# EasyEDA Pro project core_board.eprj (continued)
## Notes on the sheets (continued)
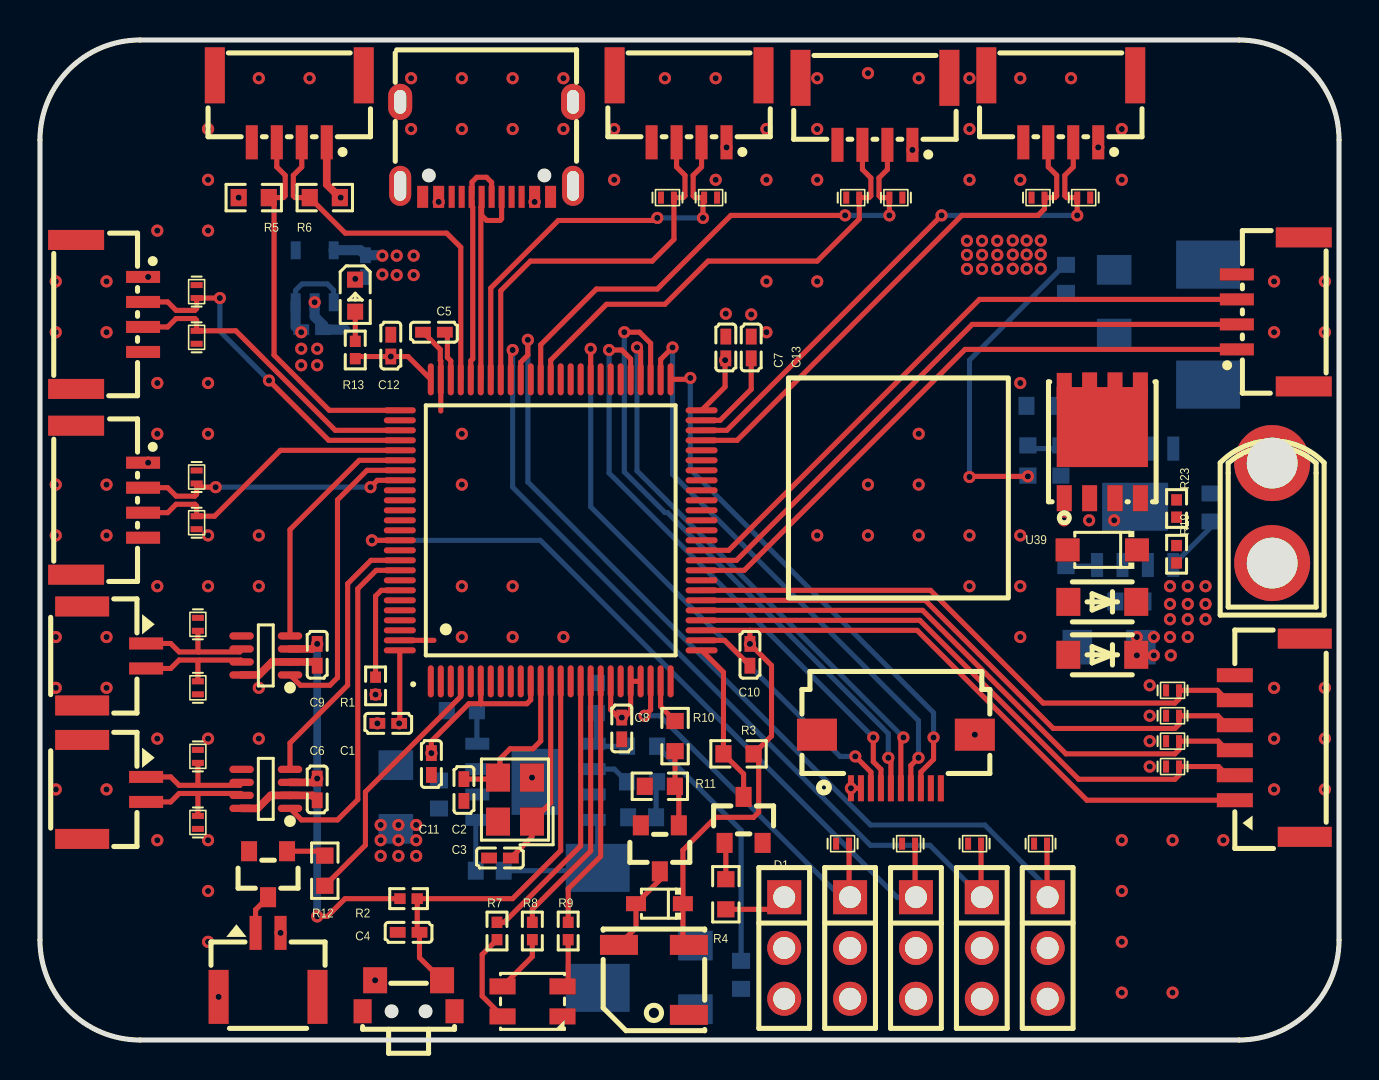
[diagram p2: board, top side]
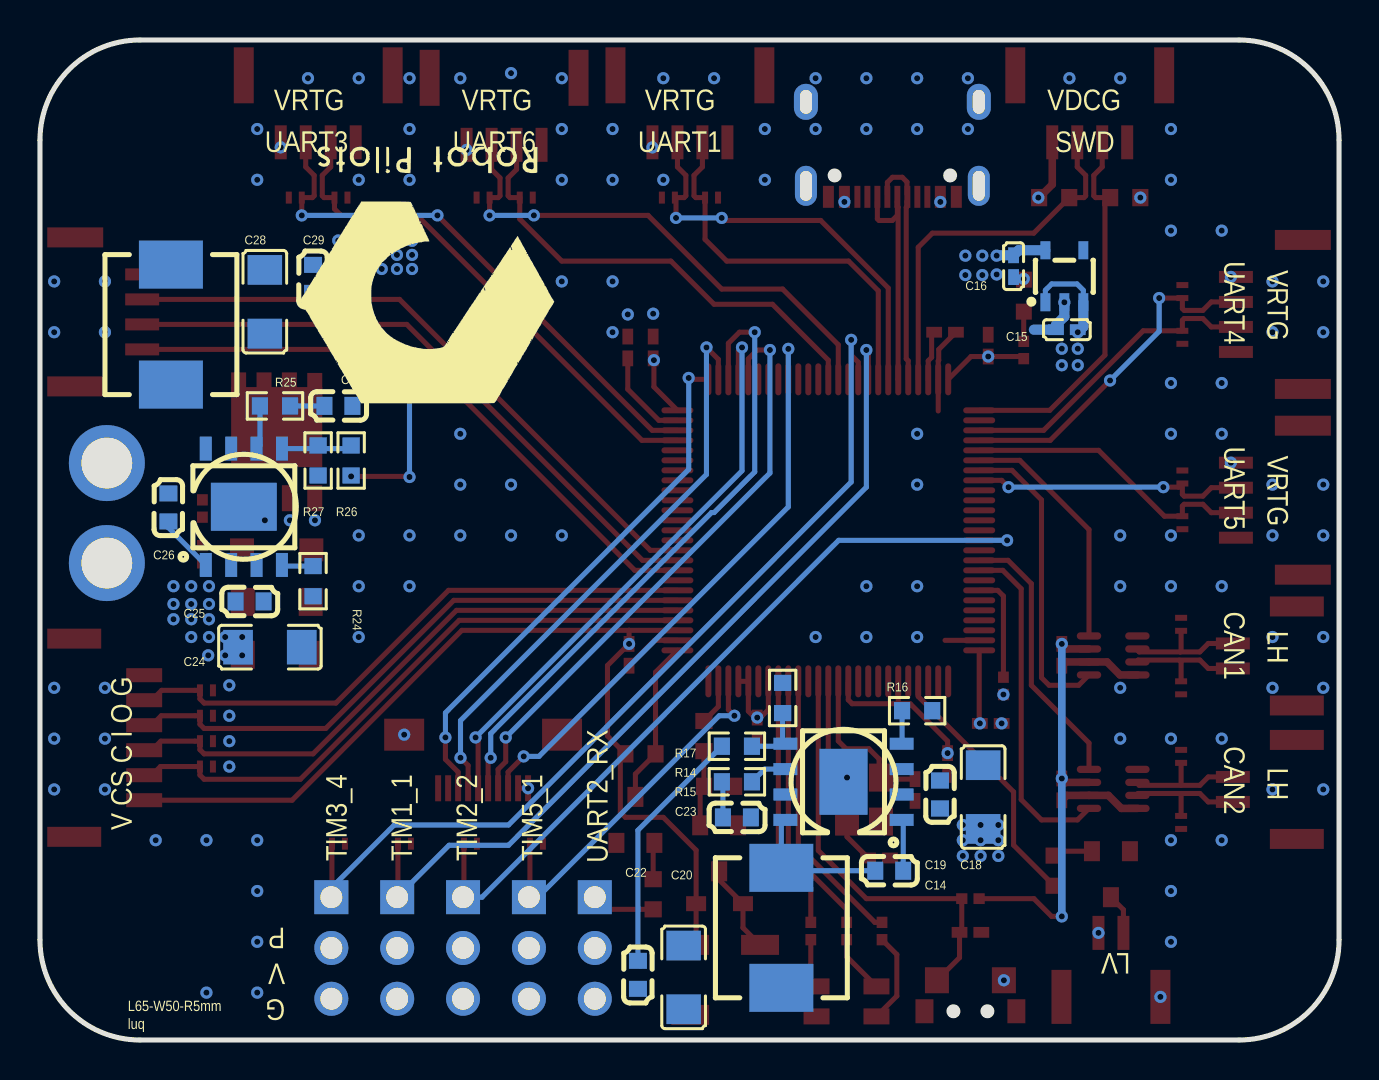
[diagram p3: board, bottom side, seen from below]

Outline 65 x 50 mm; copper layers: Top Layer, VCC, GND, Bottom Layer. Coordinates in mm from the lower left corner of the outline.
Outline path: 0,45 arc(1.46,48.54) 5,50 60,50 arc(63.54,48.54) 65,45 65,5 arc(63.54,1.46) 60,0 5,0 arc(1.46,1.46) 0,5 0,45
Stack: Top Layer 0.035mm 外层铜厚1oz / Dielectric1 0.2104mm 7628 RC49% 8.6mil / VCC 0.0152mm 内层铜厚 / Dielectric2 1.065mm 1.1mm H/HOZ 含铜 / GND 0.0152mm 内层铜厚 / Dielectric3 0.2104mm 7628 RC49% 8.6mil / Bottom Layer 0.035mm 外层铜厚1oz

## Design rules (mm)
net CAN2_L: DP8
net CAN2_H: DP8
net CAN1_L: DP7
net CAN1_H: DP7
net USB_DP: DP9
net USB_DN: DP9
template: 自定义配置
spacing copperThickness1oz (default): track to track 0.102, other pairs 0.152 to 0.3
spacing copperThickness2oz: track to track 0.203, other pairs 0.152 to 0.3
spacing 6mil: track to track 0.102, other pairs 0.152 to 0.152
track width copperThickness1oz (default): min 0.127, default 0.254, max 2.54
track width copperThickness2oz: min 0.203, default 0.254, max 2.54
track width 10mil: min 0.254, default 0.254, max 2.54
track width 20mil: min 0.508, default 0.508, max 2.54
differential pair differentialPair (default): width min 0.127, default 0.254, max 2.54; gap min 0.152, default 0.152
differential pair err=5mil: width min 0.127, default 0.254, max 2.54; gap min 0.152, default 0.254
via viaSize: diameter min 0.5, default 0.61, max 10; hole min 0.3, default 0.305, max 6.299
via 12-24 (default): diameter min 0.5, default 0.61, max 10; hole min 0.3, default 0.305, max 6.299

## Placement (name value [footprint] x y rotation side)
C1  4.7uF  [C0402]  17.43 15.83 180 top
C2  20pF  [C0402]  21.21 12.5 90 top
C3  20pF  [C0402]  23.02 9.1 180 top
C4  100nF  [C0402]  18.44 5.38 0 top
C5  10uF  [C0402]  19.71 35.39 0 top
C6  100nF  [C0402]  13.87 12.53 90 top
C7  100nF  [C0402]  34.32 34.63 270 top
C8  100nF  [C0402]  29.11 15.58 90 top
C9  100nF  [C0402]  13.87 19.26 90 top
C10  100nF  [C0402]  35.52 19.26 90 top
C11  100nF  [C0402]  19.59 13.8 90 top
C12  100nF  [C0402]  17.55 34.72 270 top
C13  10uF  [C0402]  35.59 34.63 90 top
C14  100nF  [C0603]  22.51 8.47 0 bottom
C15  100nF  [C0402]  13.62 35.52 180 bottom
C16  100nF  [C0402]  16.28 38.69 90 bottom
C18  47uF  [C1206]  17.81 12.15 90 bottom
C19  100nF  [C0603]  19.97 12.28 270 bottom
C20  47uF  [C1206]  32.79 3.13 90 bottom
C22  100nF  [C0603]  35.08 3.26 90 bottom
C23  3.3nF  [C0603]  30.13 11.13 0 bottom
C24  47uF  [C1206]  53.49 19.64 180 bottom
C25  100nF  [C0603]  54.51 21.93 0 bottom
C26  100nF  [C0603]  58.58 26.63 90 bottom
C27  3.3nF  [C0603]  50.07 31.71 0 bottom
C28  47uF  [C1206]  53.75 36.91 90 bottom
C29  100nF  [C0603]  51.34 38.06 90 bottom
CN1  L125WVS-02PW  [CONN-SMD_2P-P1.25_DELON_L125WVS-02PW]  3.71 12.53 270 top
CN2  L125WVS-02PW  [CONN-SMD_2P-P1.25_DELON_L125WVS-02PW]  3.71 19.2 270 top
CN3  L125WVS-02PW  [CONN-SMD_2P-P1.25_DELON_L125WVS-02PW]  11.41 3.76 0 top
CN4  XT30U-M  [CONN-TH_XT30U-M]  61.65 26.35 90 top
D1  1N4148WS  [SOD-323_L1.8-W1.3-LS2.5-RD]  31 6.82 180 top
FPC1  AFC01-S10FCA-00  [FPC-SMD_P0.5-10P_FGS-XJ-H2.0]  42.83 13.93 0 top
H1  -  [HDR-TH_3P-P2.54-V-M]  40.53 4.6 270 top
H2  -  [HDR-TH_3P-P2.54-V-M]  47.13 4.6 270 top
H3  -  [HDR-TH_3P-P2.54-V-M]  50.42 4.6 270 top
H4  -  [HDR-TH_3P-P2.54-V-M]  43.83 4.6 270 top
H5  -  [HDR-TH_3P-P2.54-V-M]  37.24 4.6 270 top
L1  6.8uH  [IND-SMD_L7.0-W6.6]  27.9 5.61 270 bottom
L2  6.8uH  [IND-SMD_L7.0-W6.6]  58.45 35.77 90 bottom
LED1  MHPC3528CRGBCT  [LED-SMD_4P-L3.2-W2.8-BL]  24.64 1.93 0 top
LED2  -  [LED_0603]  15.78 37.17 270 top
Q1  -  [S8050_SOT-23]  35.08 11.01 270 top
Q2  -  [S8050_SOT-23]  31.14 9.58 90 top
Q3  -  [S8050_SOT-23]  11.54 8.29 90 top
Q4  XC6220B331MR-G  [SOT-25_L3.0-W1.6-P0.95-LS2.8-TL]  13.74 38.19 90 bottom
Q5  BSC0702LS  [PG-TDSON-8_L5.0-W6.0-P1.27-BL-EP]  53.15 29.91 0 top
R1  10K  [R0402]  16.79 17.71 270 top
R2  10K  [R0402]  18.44 7.07 180 top
R3  4.7K  [R0603]  34.95 14.31 0 top
R4  4.7K  [R0603]  34.32 7.29 270 top
R5  10K  [R0603]  10.7 42.12 180 top
R6  10K  [R0603]  14.25 42.12 0 top
R7  100R  [R0402]  22.87 5.45 90 top
R8  100R  [R0402]  24.64 5.45 90 top
R9  100R  [R0402]  26.43 5.45 90 top
R10  1K  [R0603]  31.78 15.2 90 top
R11  10K  [R0603]  31.02 12.69 0 top
R12  4.7K  [R0603]  14.25 8.47 90 top
R13  100R  [R0402]  15.78 34.5 270 top
R14  50K  [R0603]  30.13 14.69 0 bottom
R15  33K  [R0603]  30.13 12.91 180 bottom
R16  200K  [R0603]  21.11 16.47 0 bottom
R17  10K  [R0603]  27.84 17.1 270 bottom
R19  50K  [R0402]  56.87 24.29 270 top
R23  10K  [R0402]  56.87 26.57 90 top
R24  200K  [R0603]  51.34 22.94 90 bottom
R25  33K  [R0603]  53.24 31.7 0 bottom
R26  50K  [R0603]  49.43 28.98 270 bottom
R27  10K  [R0603]  51.08 28.98 90 bottom
SW1  TS24CA  [SW-SMD_TS24CA]  18.44 2.21 180 top
U1  STM32F407VET6  [LQFP-100_L14.0-W14.0-P0.50-LS16.0-BL]  25.55 25.48 0 top
U2  PESD5V0F1BL  [SOD-882_L1.0-W0.6-BI]  40.16 9.82 0 top
U3  WAFER-GH1.25-4PLB  [CONN-SMD_4P-P1.25_XUNPU_WAFER-GH1.25-4PLB]  32.48 46.56 180 top
U4  WAFER-GH1.25-4PLB  [CONN-SMD_4P-P1.25_XUNPU_WAFER-GH1.25-4PLB]  51.08 46.56 180 top
U5  PESD5V0F1BL  [SOD-882_L1.0-W0.6-BI]  31.4 42.12 0 top
U6  PESD5V0F1BL  [SOD-882_L1.0-W0.6-BI]  33.56 42.12 180 top
U7  PESD5V0F1BL  [SOD-882_L1.0-W0.6-BI]  49.94 42.12 0 top
U8  PESD5V0F1BL  [SOD-882_L1.0-W0.6-BI]  52.23 42.12 180 top
U9  PESD5V0F1BL  [SOD-882_L1.0-W0.6-BI]  46.76 9.82 0 top
U10  WAFER-GH1.25-4PLB  [CONN-SMD_4P-P1.25_XUNPU_WAFER-GH1.25-4PLB]  3.48 36.28 270 top
U11  WAFER-GH1.25-4PLB  [CONN-SMD_4P-P1.25_XUNPU_WAFER-GH1.25-4PLB]  3.48 26.99 270 top
U12  PESD5V0F1BL  [SOD-882_L1.0-W0.6-BI]  50.07 9.82 0 top
U13  PESD5V0F1BL  [SOD-882_L1.0-W0.6-BI]  7.84 35.14 90 top
U14  PESD5V0F1BL  [SOD-882_L1.0-W0.6-BI]  7.84 37.42 270 top
U15  PESD5V0F1BL  [SOD-882_L1.0-W0.6-BI]  7.84 25.86 90 top
U16  PESD5V0F1BL  [SOD-882_L1.0-W0.6-BI]  7.84 28.15 270 top
U17  PESD5V0F1BL  [SOD-882_L1.0-W0.6-BI]  43.46 9.82 0 top
U18  WAFER-GH1.25-4PLB  [CONN-SMD_4P-P1.25_XUNPU_WAFER-GH1.25-4PLB]  41.78 46.43 180 top
U19  WAFER-GH1.25-4PLB  [CONN-SMD_4P-P1.25_XUNPU_WAFER-GH1.25-4PLB]  61.56 36.41 90 top
U20  PESD5V0F1BL  [SOD-882_L1.0-W0.6-BI]  40.67 42.12 0 top
U21  PESD5V0F1BL  [SOD-882_L1.0-W0.6-BI]  42.83 42.12 180 top
U22  WAFER-GH1.25-4PLB  [CONN-SMD_4P-P1.25_XUNPU_WAFER-GH1.25-4PLB]  12.47 46.56 180 top
U23  MAX3051EKA+T  [SOT-23-8_L3.0-W1.7-P0.65-LS2.8-TL]  11.3 12.56 180 top
U24  KLJ-5025-5040  [BUZ-SMD_3P-L5.0-W5.0-BL]  30.72 3.01 180 top
U25  PESD5V0F1BL  [SOD-882_L1.0-W0.6-BI]  7.9 14.18 270 top
U26  PESD5V0F1BL  [SOD-882_L1.0-W0.6-BI]  7.9 10.88 90 top
U27  MAX3051EKA+T  [SOT-23-8_L3.0-W1.7-P0.65-LS2.8-TL]  11.3 19.23 180 top
U28  HC-GH-6PWT  [CONN-SMD_6P-P1.25_HCTL_HC-GH-6PWT]  61.54 15.11 90 top
U29  PESD5V0F1BL  [SOD-882_L1.0-W0.6-BI]  7.9 20.78 270 top
U30  PESD5V0F1BL  [SOD-882_L1.0-W0.6-BI]  7.9 17.61 90 top
U31  PESD5V0F1BL  [SOD-882_L1.0-W0.6-BI]  56.67 16.21 0 top
U32  PESD5V0F1BL  [SOD-882_L1.0-W0.6-BI]  56.67 14.94 0 top
U33  PESD5V0F1BL  [SOD-882_L1.0-W0.6-BI]  56.67 13.67 0 top
U34  PESD5V0F1BL  [SOD-882_L1.0-W0.6-BI]  56.67 17.48 0 top
U37  SMF22A  [SOD-123FL_L2.8-W1.9-LS3.7-RD]  53.15 19.26 180 top
U38  SMF22A  [SOD-123FL_L2.8-W1.9-LS3.7-RD]  53.15 21.91 180 top
U39  SMF12A  [SOD-123FL_L2.7-W1.8-LS3.7-RD]  53.15 24.51 180 top
U40  SCT2450QSTER  [ESOP-8_L4.9-W3.9-P1.27-LS6.0-BL-EP]  54.8 26.66 180 bottom
U41  SCT2450QSTER  [ESOP-8_L4.9-W3.9-P1.27-LS6.0-BL-EP]  24.79 12.91 90 bottom
USB1  TYPE-C 16PIN 2MD(073)  [USB-C-SMD_TYPE-C-6PIN-2MD-073]  22.35 44.53 180 top
X1  25MHz  [CRYSTAL-SMD_4P-L3.2-W2.5-BL]  23.77 12.02 90 top

## Footprints (pads in the part's own frame, mm; a bottom-side part is the same pattern mirrored in y, then rotated)
BUZ-SMD_3P-L5.0-W5.0-BL
  rect 1.9x1 smd: 1(-1.75,-1.75) 2(1.75,-1.75) 3(-1.75,1.75)
C0402
  rect 0.79x0.54 smd: 1(-0.545,0) 2(0.545,0)
C0603
  rect 0.8x0.9 smd: 1(-0.7,0) 2(0.7,0)
C1206
  rect 1.485x1.728 smd: 1(-1.593,0) 2(1.593,0)
CONN-SMD_2P-P1.25_DELON_L125WVS-02PW
  rect 0.6x1.7 smd: 1(-0.625,1.6) 2(0.625,1.6)
  rect 1x2.7 smd: 3(2.475,-1.6) 4(-2.475,-1.6)
CONN-SMD_4P-P1.25_XUNPU_WAFER-GH1.25-4PLB
  rect 0.6x1.7 smd: 1(-1.875,1.675) 2(-0.625,1.675) 3(0.625,1.675) 4(1.875,1.675)
  rect 1x2.8 smd: 5(-3.725,-1.675) 6(3.725,-1.675)
CONN-SMD_6P-P1.25_HCTL_HC-GH-6PWT
  rect 0.7x1.8 smd: 1(-3.125,1.75) 2(-1.875,1.75) 3(-0.625,1.75) 4(0.625,1.75) 5(1.875,1.75) 6(3.125,1.75)
  rect 1x2.7 smd: 7(4.955,-1.75) 8(-4.955,-1.75)
CONN-TH_XT30U-M
  round 3.8 hole 2.54: 1(-2.5,0) 2(2.5,0)
CRYSTAL-SMD_4P-L3.2-W2.5-BL
  rect 1.4x1.2 smd: 1(-1.1,-0.85) 2(1.1,-0.85) 3(1.1,0.85) 4(-1.1,0.85)
ESOP-8_L4.9-W3.9-P1.27-LS6.0-BL-EP
  rect 0.6x1.2 smd: 1(-1.905,-2.909) 2(-0.635,-2.909) 3(0.635,-2.909) 4(1.905,-2.909) 5(1.905,2.909) 6(0.635,2.909) 7(-0.635,2.909) 8(-1.905,2.909)
  rect 3.3x2.4 smd: 9(0,0)
FPC-SMD_P0.5-10P_FGS-XJ-H2.0
  rect 0.3x1.3 smd: 1(-2.25,-1.339) 2(-1.75,-1.339) 3(-1.25,-1.34) 4(-0.75,-1.339) 5(-0.25,-1.34) 6(0.25,-1.339) 7(0.75,-1.339) 8(1.25,-1.339) 9(1.75,-1.339) 10(2.25,-1.34)
  rect 2x1.6 smd: 11(3.95,1.34) 12(-3.95,1.34)
HDR-TH_3P-P2.54-V-M
  rect 1.7x1.7 hole 1.1: 1(-2.54,0)
  round 1.7 hole 1.1: 2(0,0) 3(2.54,0)
IND-SMD_L7.0-W6.6
  rect 2.4x3.2 smd: 1(-3,0) 2(3,0)
LED-SMD_4P-L3.2-W2.8-BL
  rect 1.3x0.8 smd: 1(-1.5,-0.75) 2(-1.5,0.75) 3(1.5,0.75) 4(1.5,-0.75)
LED_0603
  rect 0.8x0.8 smd: 1(-0.851,-0.01) 2(0.75,-0.005)
LQFP-100_L14.0-W14.0-P0.50-LS16.0-BL
  oval 0.3x1.6 smd: 1(-6,-7.55) 2(-5.5,-7.55) 3(-5,-7.55) 4(-4.5,-7.55) 5(-4,-7.55) 6(-3.5,-7.55) 7(-3,-7.55) 8(-2.5,-7.55) 9(-2,-7.55) 10(-1.5,-7.55) 11(-1,-7.55) 12(-0.5,-7.55) 13(0,-7.55) 14(0.5,-7.55) 15(1,-7.55) 16(1.5,-7.55) 17(2,-7.55) 18(2.5,-7.55) 19(3,-7.55) 20(3.5,-7.55) 21(4,-7.55) 22(4.5,-7.55) 23(5,-7.55) 24(5.5,-7.55) 25(6,-7.55) 51(6,7.55) 52(5.5,7.55) 53(5,7.55) 54(4.5,7.55) 55(4,7.55) 56(3.5,7.55) 57(3,7.55) 58(2.5,7.55) 59(2,7.55) 60(1.5,7.55) 61(1,7.55) 62(0.5,7.55) 63(0,7.55) 64(-0.5,7.55) 65(-1,7.55) 66(-1.5,7.55) 67(-2,7.55) 68(-2.5,7.55) 69(-3,7.55) 70(-3.5,7.55) 71(-4,7.55) 72(-4.5,7.55) 73(-5,7.55) 74(-5.5,7.55) 75(-6,7.55)
  oval 1.6x0.3 smd: 26(7.55,-6) 27(7.55,-5.5) 28(7.55,-5) 29(7.55,-4.5) 30(7.55,-4) 31(7.55,-3.5) 32(7.55,-3) 33(7.55,-2.5) 34(7.55,-2) 35(7.55,-1.5) 36(7.55,-1) 37(7.55,-0.5) 38(7.55,0) 39(7.55,0.5) 40(7.55,1) 41(7.55,1.5) 42(7.55,2) 43(7.55,2.5) 44(7.55,3) 45(7.55,3.5) 46(7.55,4) 47(7.55,4.5) 48(7.55,5) 49(7.55,5.5) 50(7.55,6) 76(-7.55,6) 77(-7.55,5.5) 78(-7.55,5) 79(-7.55,4.5) 80(-7.55,4) 81(-7.55,3.5) 82(-7.55,3) 83(-7.55,2.5) 84(-7.55,2) 85(-7.55,1.5) 86(-7.55,1) 87(-7.55,0.5) 88(-7.55,0) 89(-7.55,-0.5) 90(-7.55,-1) 91(-7.55,-1.5) 92(-7.55,-2) 93(-7.55,-2.5) 94(-7.55,-3) 95(-7.55,-3.5) 96(-7.55,-4) 97(-7.55,-4.5) 98(-7.55,-5) 99(-7.55,-5.5) 100(-7.55,-6)
PG-TDSON-8_L5.0-W6.0-P1.27-BL-EP
  rect 0.75x1.3 smd: 1(-1.905,-2.82) 2(-0.635,-2.82) 3(0.635,-2.82) 4(1.905,-2.82) 5(1.905,2.82) 6(0.635,2.82) 7(-0.635,2.82) 8(-1.905,2.794)
  rect 4.56x4 smd: 8(0,0.737)
R0402
  rect 0.566x0.54 smd: 1(-0.433,0) 2(0.433,0)
R0603
  rect 0.806x0.864 smd: 1(-0.753,0) 2(0.753,0)
S8050_SOT-23
  rect 1x0.8 smd: 1(1.15,-0.823) 2(1.15,1.077) 3(-1.15,0.127)
SOD-123FL_L2.7-W1.8-LS3.7-RD
  rect 1.2x1.15 smd: 1(-1.735,0) 2(1.735,0)
SOD-123FL_L2.8-W1.9-LS3.7-RD
  rect 1.2x1.4 smd: 1(-1.7,0) 2(1.7,0)
SOD-323_L1.8-W1.3-LS2.5-RD
  rect 1x0.75 smd: 1(-1.173,0) 2(1.173,0)
SOD-882_L1.0-W0.6-BI
  rect 0.3x0.6 smd: 1(-0.325,0) 2(0.325,0)
SOT-23-8_L3.0-W1.7-P0.65-LS2.8-TL
  oval 1.222x0.364 smd: 1(-1.211,0.975) 2(-1.211,0.325) 3(-1.211,-0.325) 4(-1.211,-0.975) 5(1.211,-0.975) 6(1.211,-0.325) 7(1.211,0.325) 8(1.211,0.975)
SOT-25_L3.0-W1.6-P0.95-LS2.8-TL
  rect 0.9x0.5 smd: 1(-1.3,0.95) 2(-1.3,0) 3(-1.3,-0.95) 4(1.3,-0.95) 5(1.3,0.95)
SW-SMD_TS24CA
  rect 0.9x1.2 smd: 1(-2.3,0.775) 2(2.3,0.775)
  rect 1.2x1.3 smd: 3(-1.675,-0.775) 4(1.675,-0.775)
USB-C-SMD_TYPE-C-6PIN-2MD-073
  rect 0.55x1.1 smd: 1(-3.2,2.375) 2(-2.4,2.375) 11(2.4,2.375) 12(3.2,2.375)
  rect 0.3x1.1 smd: 3(-1.75,2.375) 4(-1.25,2.375) 5(-0.75,2.375) 6(-0.25,2.375) 7(0.25,2.375) 8(0.75,2.375) 9(1.25,2.375) 10(1.75,2.375)
  oval 1.1x2 hole 0.6x1.5: 13(-4.325,1.825) 14(4.325,1.825)
  oval 1.2x1.8 hole 0.6x1.2: 13(-4.325,-2.375) 14(4.325,-2.375)

## Nets
As in the schematic.

Pads without a net: Q4 4; U1 1 2 3 5 7 8 9 15 25 33 37 38 39 40 41 42 43 44 45 46 56 57 58 60 61 62 65 77 84 85 86 87 88 90 93 95 96 97 98; U23 5; U27 5; U40 3; U41 3; USB1 3 4 9 10

## Via types
v1: diameter 0.61, hole 0.305, Top Layer to Bottom Layer, 223 vias

## Routing (per net, layer and track width the routed paths; a pad name or vN(x,y) marks a point on that pad's centre or on a via; arc(x,y) is an arc through that point)
+3.3V: length 102.7
  Top Layer w0.254: U1.19 28.55,16.51 29.07,16 29.11,16 29.55,16.44 U1.21 U1.22 ; U1.100 18.01,15.86 v1(17.97,15.83) ; U1.11 24.55,17.01 24.36,16.81 22.05,16.81 ; R13.2 15.88,34.17 v1(17.55,34.17) 18.41,34.17 U1.75 ; v1(13.87,6.18) 14.38,6.18 15.27,7.07 R2.2 ; 35.52,20.48 43.89,20.48 52.38,11.99 59.4,11.99 ; 35.52,20.48 U1.28 ; 35.52,20.48 35.52,20.48 v1(35.52,19.81) 36.6,18.73 36.6,15.2 R3.2 35.96,14.31 35.96,11.39 35.71,11.13 33.81,11.13 32.17,9.49 D1.1 32.17,5.06 U24.1 ; 22.05,16.81 U1.6 ; 22.05,16.81 21.46,16.81 19.59,14.94 v1(19.59,14.34) ; v1(34.28,33.99) 34.28,32.66 U1.50
  Top Layer w0.381: v1(13.87,19.81) 13.62,19.55 U27.3 ; R6.2 14.35,42.78 14.35,44.63 ; U23.3 13.68,12.88 v1(13.87,13.07)
  VCC w0.254: v1(13.87,13.07) 15.21,13.07 v1(17.97,15.83)
  Bottom Layer w0.381: v1(13.87,19.81) v1(13.87,13.07) v1(13.87,6.18)
  vias: v1(9.94,42.12) v1(15.05,42.12) v1(17.13,39.22) v1(17.13,38.28) v1(17.85,39.22) v1(17.85,38.25) v1(18.7,39.22) v1(18.7,38.25) v1(29.11,16.12)
+5V: length 21.2
  Top Layer w0.254: v1(46.51,28.15) 46.54,28.18 v1(49.43,28.18) ; v1(40.58,12.59) FPC1.2
  Bottom Layer w0.254: 51.46,38.69 51.21,38.69 46.51,33.99 v1(46.51,28.15) ; 14.69,36.88 14.69,37.49 14.38,37.8 13.11,37.8 12.79,37.49 Q4.3
  Bottom Layer w0.508: v1(13.07,35.39) 12.79,35.67 Q4.3
  vias: v1(5.41,38.15) v1(5.41,28.87) v1(12.04,5.36) v1(13.07,34.56) v1(13.07,33.74) v1(13.87,34.56) v1(13.87,33.74) v1(19.95,41.9) v1(24.75,41.9) v1(34.35,44.63) v1(43.65,44.5) v1(46.38,39.96) v1(46.38,39.26) v1(46.38,38.55) v1(47.14,39.96) v1(47.14,39.26) v1(47.14,38.55) v1(47.9,39.96) v1(47.9,39.26) v1(47.9,38.55) v1(48.67,39.97) v1(48.67,38.56) v1(48.68,39.27) v1(49.37,39.97) v1(49.37,39.27) v1(49.37,38.57) v1(50.08,39.97) v1(50.08,39.27) v1(50.08,38.56) v1(52.95,44.63)
+5V_PWM: length 12.8
  Bottom Layer w0.254: 34.95,3.7 35.08,3.83 35.08,10.49 R14.2
+24V:
  vias: v1(17.05,10.75) v1(17.05,9.99) v1(17.05,9.2) v1(17.93,10.75) v1(17.93,9.99) v1(17.93,9.2) v1(18.82,10.75) v1(18.82,9.99) v1(18.82,9.2) v1(54.88,20.15) v1(54.88,19.23) v1(55.73,20.15) v1(55.73,19.23) v1(56.54,22.69) v1(56.54,21.8) v1(56.54,21.04) v1(56.54,20.15) v1(56.58,19.23) v1(57.43,22.69) v1(57.43,21.8) v1(57.43,21.04) v1(57.43,20.15) v1(58.32,22.69) v1(58.32,21.8) v1(58.32,21.04)
GND: length 19.9
  Top Layer w0.254: C10.1 34.26,19.98 U1.27 ; 20.05,31.45 U1.74 20.05,33.96 20.03,33.99 20.03,34.53 C5.1 ; U1.99 19.71,19.98
  Top Layer w0.381: C6.1 13.62,12.23 U23.2 11.54,12.23 10.89,11.58 10.09,11.58 ; U27.8 10.96,18.25 11.61,18.9 U27.2 13.68,18.9 C9.1
  Bottom Layer w0.508: 15.27,35.52 C15.1 14.16,35.75 13.74,36.17 v1(13.74,36.89)
  vias: v1(0.79,37.93) v1(0.79,35.39) v1(0.79,27.77) v1(0.79,25.23) v1(0.79,20.15) v1(0.79,17.61) v1(0.79,12.53) v1(3.33,37.93) v1(3.33,35.39) v1(3.33,27.77) v1(3.33,25.23) v1(3.33,20.15) v1(3.33,17.61) v1(3.33,12.53) v1(5.87,40.47) v1(5.87,32.85) v1(5.87,30.31) v1(5.87,22.69) v1(5.87,15.07) v1(5.87,9.99) v1(8.41,45.55) v1(8.41,43.01) v1(8.41,40.47) v1(8.41,32.85) v1(8.41,30.31) v1(8.41,25.23) v1(8.41,22.69) v1(8.41,15.07) v1(8.41,9.99) v1(8.41,7.45) v1(8.41,4.91) v1(8.94,2.16) v1(10.95,48.09) v1(10.95,25.23) v1(10.95,22.69) v1(10.95,17.61) v1(10.95,15.07) v1(13.49,48.09) v1(15.78,38.06) v1(16.77,2.99) v1(16.79,17.27) v1(16.88,15.83) v1(18.57,48.09) v1(18.57,45.55) v1(21.11,48.09) v1(21.11,45.55) v1(21.11,30.31) v1(21.11,27.77) v1(21.11,22.69) v1(21.11,20.15) v1(23.65,48.09) v1(23.65,45.55) v1(23.65,22.69) v1(23.65,20.15) v1(24.62,13.12) v1(26.19,48.09) v1(26.19,45.55) v1(26.19,20.15) v1(28.73,45.55) v1(28.73,43.01) v1(31.27,48.09) v1(33.81,48.09) v1(33.81,43.01) v1(34.32,36.31) v1(35.59,36.28) v1(36.35,45.55) v1(36.35,43.01) v1(36.35,37.93) v1(36.35,35.39) v1(38.89,48.09) v1(38.89,45.55) v1(38.89,43.01) v1(38.89,37.93) v1(38.89,25.23) v1(41.43,48.34) v1(41.43,27.77) v1(41.43,25.23) v1(43.97,48.09) v1(43.97,30.31) v1(43.97,27.77) v1(43.97,25.23) v1(46.51,48.09) v1(46.51,45.55) v1(46.51,43.01) v1(46.51,25.23) v1(46.51,22.69) v1(46.78,15.27) v1(49.05,48.09) v1(49.05,43.01) v1(49.05,32.85) v1(49.05,25.23) v1(49.05,22.69) v1(49.05,20.15) v1(51.24,25.99) v1(51.59,48.09) v1(52.49,25.99) v1(53.75,25.99) v1(54.13,45.55) v1(54.13,43.01) v1(54.13,9.99) v1(54.13,7.45) v1(54.13,4.91) v1(54.13,2.37) v1(55.53,17.74) v1(55.53,16.21) v1(55.53,14.94) v1(55.53,13.67) v1(56.67,9.99) v1(56.67,2.37) v1(59.21,9.99) v1(61.75,37.93) v1(61.75,35.39) v1(61.75,17.61) v1(61.75,15.07) v1(61.75,12.53) v1(64.29,37.93) v1(64.29,35.39) v1(64.29,17.61) v1(64.29,15.07) v1(64.29,12.53)
$C2_2: length 8.1
  Top Layer w0.254: C2.2 22.84,13.05 X1.3 23.02,13.22 23.02,14.05 23.52,14.56 24.67,14.56 25.05,14.95 U1.12
$C3_1: length 9.7
  Top Layer w0.254: U1.13 25.55,11.86 24.62,10.92 24.62,10.16 C3.1
$C4_2: length 21.2
  Top Layer w0.254: SW1.3 18.99,4.12 C4.2 18.88,5.49 R2.1 23.65,7.07 26.05,9.47 U1.14
$C5_2: length 2.4
  Top Layer w0.254: 20.39,35.39 20.39,34.13 20.55,33.96 U1.73
$C13_1: length 4.7
  Top Layer w0.254: U1.49 34.03,30.98 35.59,32.54 C13.1
$C14_1: length 2.6
  Bottom Layer w0.254: U41.1 21.81,10.93 C14.1
$C14_2: length 7.2
  Bottom Layer w0.254: C14.2 27.76,8.47 L1.1 27.9,10.8 U41.8
$C23_2: length 1.8
  Bottom Layer w0.254: C23.2 30.83,12.86 R15.1
$C26_1: length 2.9
  Bottom Layer w0.254: U40.1 58.58,25.62 C26.1
$C27_2: length 1.7
  Bottom Layer w0.254: C27.2 50.77,31.7 R25.1
$CN3_1: length 2
  Top Layer w0.254: Q3.3 10.79,6.51 CN3.1
$D1_2: length 4.5
  Top Layer w0.254: 31.02,8.43 31.02,8.01 D1.2 29.82,5.61 U24.2
$H5_1: length 3.2
  Top Layer w0.254: 34.32,6.53 36.63,6.53 37.24,7.14
$LED1_1: length 4.6
  Top Layer w0.254: R7.1 22.13,4.28 22.13,2.2 LED1.1
$LED1_2: length 3
  Top Layer w0.254: R8.1 24.64,4.17 LED1.2
$LED1_3: length 2.5
  Top Layer w0.254: R9.1 26.43,2.97 LED1.3
$LED2_2: length 1.5
  Top Layer w0.254: 15.78,34.93 15.78,36.41 LED2.2
$Q1_1: length 1.8
  Top Layer w0.254: Q1.1 34.32,9.79 R4.1
$Q2_1: length 3.8
  Top Layer w0.254: R10.1 31.78,12.69 R11.2 31.97,12.49 Q2.1
$Q3_1: length 2
  Top Layer w0.254: R12.2 14.03,9.44 Q3.1
$R1_1: length 5.4
  Top Layer w0.254: U1.94 17.08,22.48 16.79,22.2 R1.1
$R14_1: length 3.3
  Bottom Layer w0.254: R17.2 27.84,14.95 U41.5 27.83,14.69 R14.1
$R15_2: length 1.9
  Bottom Layer w0.254: U41.6 28.74,13.55 R15.2
$R16_2: length 1.7
  Bottom Layer w0.254: R16.2 21.86,14.84 U41.4
$R24_2: length 1.6
  Bottom Layer w0.254: R24.2 52.84,23.7 U40.4
$R25_2: length 2.2
  Bottom Layer w0.254: R25.2 53.99,29.74 54.16,29.57
$R26_1: length 3.5
  Bottom Layer w0.254: R26.1 49.59,29.57 52.89,29.57
ADC_IN8: length 31.3
  Top Layer w0.254: U1.35 34.85,23.98 46.65,35.78 59.51,35.78
ADC_IN9: length 31.6
  Top Layer w0.254: 59.51,37.03 47.01,37.03 34.46,24.48 U1.36
ADC_IN15: length 31
  Top Layer w0.254: U1.34 35.24,23.48 46.29,34.53 59.51,34.53
CAN1_H: length 5.9
  Top Layer w0.254: 7.99,18.99 7.9,18.9 U30.2 ; 5.56,18.58 6.54,18.58 6.96,19 10.05,19 10.09,18.96 U27.7
CAN1_L: length 5.9
  Top Layer w0.254: U29.2 7.9,19.45 7.95,19.4 ; 7.95,19.4 6.96,19.4 6.54,19.83 5.56,19.83 ; 7.95,19.4 10,19.4 10.09,19.49 U27.6
CAN1_RX: length 12.2
  Top Layer w0.254: U1.81 15.97,28.98 12.51,25.52 U27.4
CAN1_TX: length 15.4
  Top Layer w0.254: U1.82 16.36,28.48 14.89,27.01 14.89,18.12 14.51,17.74 13.03,17.74 U27.1
CAN2_H: length 5.9
  Top Layer w0.254: U23.7 10.09,12.29 10.05,12.33 6.96,12.33 6.54,11.9 5.56,11.9 ; U26.2 7.9,12.33
CAN2_L: length 5.9
  Top Layer w0.254: U23.6 10.09,12.82 10,12.73 6.96,12.73 6.54,13.15 5.56,13.15 ; U25.2 7.9,12.73
CAN2_RX: length 13.6
  Top Layer w0.254: U1.91 16.56,23.98 15.39,22.82 15.39,17.74 12.51,14.85 U23.4
CAN2_TX: length 17.1
  Top Layer w0.254: U1.92 16.82,23.48 15.9,22.56 15.9,12.02 14.89,11.01 13.09,11.01 12.51,11.58
IMU_INT: length 29.8
  Top Layer w0.254: v1(41.7,15.13) 41.7,13.91 42.08,13.53 FPC1.4 ; U1.55 29.55,34.06 29.11,34.5 v1(28.48,34.5)
  Bottom Layer w0.254: v1(41.7,15.13) 28.48,28.35 v1(28.48,34.5)
LASER: length 13
  Top Layer w0.254: R12.1 16.28,9.74 16.28,12.41 21.05,17.18 U1.4
LED_B: length 12.7
  Top Layer w0.254: U1.18 28.05,9.19 26.43,7.56 R9.2
LED_G: length 13.3
  Top Layer w0.254: U1.17 27.55,9.45 24.64,6.53 R8.2
LED_R: length 14
  Top Layer w0.254: U1.16 27.05,9.71 23.23,5.88 R7.2
SPI1_CS: length 30.3
  Top Layer w0.254: 59.4,13.24 58.97,13.67 U33.2 56.99,13.25 56.79,13.04 51.97,13.04 44.02,20.98 U1.29
SPI1_MISO: length 29.7
  Top Layer w0.254: U1.31 44.3,21.98 50.7,15.58 56.79,15.58 56.99,15.79 U31.2 58.93,16.21 59.4,15.74
SPI1_MOSI: length 29.4
  Top Layer w0.254: U1.32 44.56,22.48 50.19,16.85 56.79,16.85 56.99,17.06 U34.2 58.91,17.48 59.4,16.99
SPI1_SCK: length 30
  Top Layer w0.254: U1.30 44.16,21.48 51.34,14.31 56.79,14.31 56.99,14.52 U32.2 58.95,14.94 59.4,14.49
SPI2_CS: length 26.8
  Top Layer w0.254: FPC1.8 44.08,13.4 44.71,14.03 v1(44.71,15.13) ; U1.51 32.47,33.03 v1(32.54,33.1)
  Bottom Layer w0.254: v1(44.71,15.13) 44.71,16.36 32.54,28.53 v1(32.54,33.1)
SPI2_MISO: length 31.8
  Top Layer w0.254: FPC1.5 42.58,13.98 v1(42.45,14.11) ; v1(29.24,35.39) 30,35.39 30.55,34.83 U1.53
  Bottom Layer w0.254: v1(42.45,14.11) 42.45,14.11 42.45,15.32 31.4,26.37 31.27,26.37 29.24,28.4 v1(29.24,35.39)
SPI2_MOSI: length 29.3
  Top Layer w0.254: FPC1.6 43.08,15 v1(43.2,15.13) ; U1.54 30.05,34.45 v1(29.87,34.63)
  Bottom Layer w0.254: v1(43.2,15.13) 29.87,28.46 v1(29.87,34.63)
SPI2_SCK: length 29.1
  Top Layer w0.254: U1.52 31.05,34.03 v1(31.65,34.63) ; FPC1.7 43.58,13.73 v1(43.96,14.11)
  Bottom Layer w0.254: v1(31.65,34.63) 31.65,28.28 43.96,15.97 v1(43.96,14.11)
SWCLK: length 18.9
  Top Layer w0.254: U1.76 14.48,31.48 11.71,34.25 11.71,41.86 R5.1 12.18,42.12 12.27,42.21 12.27,43.23 11.85,43.65 11.85,44.63
SWDIO: length 18.6
  Top Layer w0.254: U1.72 21.05,39.64 20.35,40.34 15.28,40.34 R6.1 12.77,42.12 12.68,42.21 12.68,43.23 13.1,43.65 13.1,44.63
TIM1_CH1: length 43
  Top Layer w0.254: U1.67 23.55,34.41 v1(23.65,34.5) ; U9.2 47.09,7.18 47.13,7.14
  Bottom Layer w0.254: v1(23.65,34.5) 23.65,27.64 41.56,9.74 44.53,9.74 47.13,7.14
TIM2_CH2: length 38.7
  Top Layer w0.254: 43.83,7.14 43.79,7.18 U17.2 ; U1.89 v1(16.61,24.98)
  Bottom Layer w0.254: 43.83,7.14 42.88,7.14 25.04,24.98 v1(16.61,24.98)
TIM3_CH4: length 46.8
  Top Layer w0.254: 50.42,7.14 50.39,7.17 U12.2 ; v1(24.41,35.01) 24.41,34.25 24.05,33.89 U1.66
  Bottom Layer w0.254: 50.42,7.14 50.42,7.6 47.27,10.75 41.56,10.75 24.41,27.9 v1(24.41,35.01)
TIM4_CH1(IMU_HEAT): length 29.7
  Top Layer w0.254: FPC1.3 41.58,13.4 v1(40.8,14.18) ; v1(27.55,34.56) U1.59
  Bottom Layer w0.254: v1(40.8,14.18) 40.03,14.18 27.55,26.66 v1(27.55,34.56)
TIM5_CH1: length 18.6
  Top Layer w0.254: 40.53,7.14 40.48,7.19 U2.2 ; U1.23 30.55,16.51 v1(30.25,16.21)
  Bottom Layer w0.254: v1(30.25,16.21) 31.02,16.21 40.09,7.14 40.53,7.14
TIM5_CH2: length 2.3
  Top Layer w0.254: U1.24 31.05,16.67 R10.2
UART4_RX: length 17.3
  Top Layer w0.254: v1(11.46,32.98) 14.45,29.98 U1.79 ; v1(9,37.1) 9,37.1 U14.2 7.84,36.57 7.75,36.48 6.81,36.48 6.39,36.9 5.41,36.9
  Bottom Layer w0.254: v1(11.46,32.98) 9,35.43 v1(9,37.1)
UART4_TX: length 15.4
  Top Layer w0.254: U1.78 14.78,30.48 9.8,35.46 U13.2 7.84,35.98 7.75,36.07 6.81,36.07 6.39,35.65 5.41,35.65
UART5_RX: length 13.6
  Top Layer w0.254: v1(8.79,27.64) 8.02,27.64 U16.2 7.84,27.28 7.75,27.19 6.81,27.19 6.39,27.62 5.41,27.62 ; v1(16.54,27.64) 16.88,27.98 U1.83
  Bottom Layer w0.254: v1(8.79,27.64) v1(16.54,27.64)
UART5_TX: length 14.7
  Top Layer w0.254: U1.80 12.03,29.48 8.73,26.19 U15.2 7.84,26.7 7.75,26.79 6.81,26.79 6.39,26.37 5.41,26.37
USART1_RX: length 20.9
  Top Layer w0.254: v1(33.17,41.1) 33.17,42.06 U6.2 32.77,42.12 32.68,42.21 32.68,43.23 33.1,43.65 33.1,44.63 ; v1(30.89,41.1) 30.76,40.98 25.94,40.98 22.55,37.6 U1.69
  Bottom Layer w0.254: 33.17,41.1 v1(30.89,41.1)
USART1_TX: length 19.4
  Top Layer w0.254: 31.85,44.63 31.85,43.65 32.27,43.23 32.27,42.21 32.18,42.12 U5.2 31.72,40.03 30.64,38.95 24.54,38.95 23.05,37.46 U1.68
USART2_RX: length 8.2
  Top Layer w0.254: Q1.3 35.21,13.3 R3.1 34.2,18.39 U1.26
USART3_RX: length 27.4
  Top Layer w0.254: v1(45.11,41.23) 34.36,30.48 U1.48 ; v1(51.9,41.23) U8.2 51.37,42.12 51.28,42.21 51.28,43.23 51.7,43.65 51.7,44.63
  Bottom Layer w0.254: 45.11,41.23 v1(51.9,41.23)
USART3_TX: length 25.8
  Top Layer w0.254: 50.45,44.63 50.45,43.65 50.87,43.23 50.87,42.21 50.78,42.12 U7.2 50.26,41.56 49.94,41.23 46.13,41.23 34.88,29.98 U1.47
USART6_RX: length 25.8
  Top Layer w0.254: v1(42.5,41.23) U21.2 42.07,42.12 41.98,42.21 41.98,43.11 42.4,43.53 42.4,44.5 ; v1(40.29,41.23) 34.57,41.23 30.89,37.55 27.84,37.55 25.05,34.76 U1.64
  Bottom Layer w0.254: v1(40.29,41.23) v1(42.5,41.23)
USART6_TX: length 23.5
  Top Layer w0.254: U1.63 25.55,33.99 28.35,36.79 31.27,36.79 33.43,38.95 38.89,38.95 40.99,41.05 U20.2 41.48,42.12 41.57,42.21 41.57,43.11 41.15,43.53 41.15,44.5
USB_DN: length 11.3
  Top Layer w0.254: 22.1,41.9 22.1,41.92 22.1,41.67 ; 22.1,41.67 22.1,41.23 22.35,40.98 23.02,40.98 23.1,41.06 23.1,41.9 ; 22.1,41.67 22.06,41.63 22.06,33.04 22.06,33.03 U1.70
USB_DP: length 11.3
  Top Layer w0.254: 21.6,41.9 21.62,41.92 21.62,41.67 21.66,41.63 21.66,34.06 21.55,33.96 U1.71 ; 21.62,42.3 21.62,42.9 21.86,43.14 22.34,43.14 22.6,42.88 22.6,42.29

## Copper pours and planes (outline as drawn; the poured copper is in the pictures)
+3.3V on Bottom Layer: 16.59,39.82 19.3,39.82 19.3,31.73 16.59,31.73
+3.3V on VCC: 9.31,45.5 9.31,41.46 16.45,34.32 16.45,13.93 36.34,13.93 36.34,34.49 24,34.49 15.64,42.86 15.64,45.46
+5V on Bottom Layer: 12.49,35.97 14.25,35.97 14.25,33.23 12.49,33.23
+5V on Bottom Layer: 45.8,40.6 60.1,40.6 60.1,38.08 45.8,38.08
+5V on VCC: 36.6,27.9 49.56,27.9 49.56,11.77 36.6,11.77
+5V on VCC: -6.96,56.22 69.75,56.22 69.75,-5.25 -6.96,-5.25
+5V_PWM on Bottom Layer: 26.32,5.85 26.32,3.41 51.69,3.41 51.69,5.85
+5V_PWM on Bottom Layer: 26.13,3.81 33.93,3.81 33.93,1.37 26.13,1.37
+5V_PWM on VCC: 51.69,5.8 51.69,3.41 28.99,3.41 28.99,5.8
+24V on Top Layer: 65,25.98 57.83,25.98 57.69,25.98 57.69,24.09 56.33,24.09 55.15,22.87 54.26,22.87 54.26,18.63 56.8,18.63 59.08,20.91 65,20.91
+24V on Bottom Layer: 65.05,25.99 65.05,18.55 54.55,18.55 54.55,22.39 55.17,23.02 55.17,24.11 57.05,25.99
+24V on Bottom Layer: 22.48,12.59 21.03,12.59 20.44,11.99 19.56,11.99 18.82,11.26 16.41,11.26 16.41,8.59 20.98,8.59 20.98,11.47 21.47,11.96 22.48,11.96
+24V on VCC: 16.4,25.98 65,25.98 65,0.54 16.4,0.54
GND on Top Layer: -7.47,56.85 69.06,56.85 69.06,-4.62 -7.47,-4.62
GND on Bottom Layer: -6.96,56.22 69.88,56.22 69.88,-5.25 -6.96,-5.25
GND on GND: -6.83,56.22 69.88,56.22 69.88,-5.25 -6.83,-5.25
PGND on Top Layer: 50.83,33.36 58.07,33.36 59.64,31.79 65,31.79 65,26.42 65,26.37 58.67,26.37 56.8,28.66 50.83,28.66
PGND on GND: 65,31.78 59.72,31.78 58.14,33.36 50.83,33.36 50.83,28.66 56.8,28.66 58.67,26.37 65,26.37
$C26_2 on Bottom Layer: 59.97,33.99 59.97,31.33 58.96,30.31 58.96,26.95 58.58,26.95 56.47,29.06 56.47,34.01 59.96,34.01
$Q5_4 on Top Layer: 54.64,27.77 55.42,27.77 56.52,26.44 57.15,26.44 57.15,24.42 55.98,24.42 55.53,23.96 54.31,23.96 54.31,26.04 54.64,26.37

## Text on the board
Bottom Silkscreen Layer: L65-W50-R5mm / luq | SWD | VDCG | VRTG | UART1 | UART3 | LH | UART5 | UART4 | LV | G / V / P | UART2_RX | TIM5_1 | TIM2_2 | TIM1_1 | TIM3_4 | V CS C I O G | UART6 | CAN1 | CAN2
